# EAGLE schematic Mk4 Prototype (EAGLE 9.0.1) (continued)
## Sheet 3 of 4 (continued)
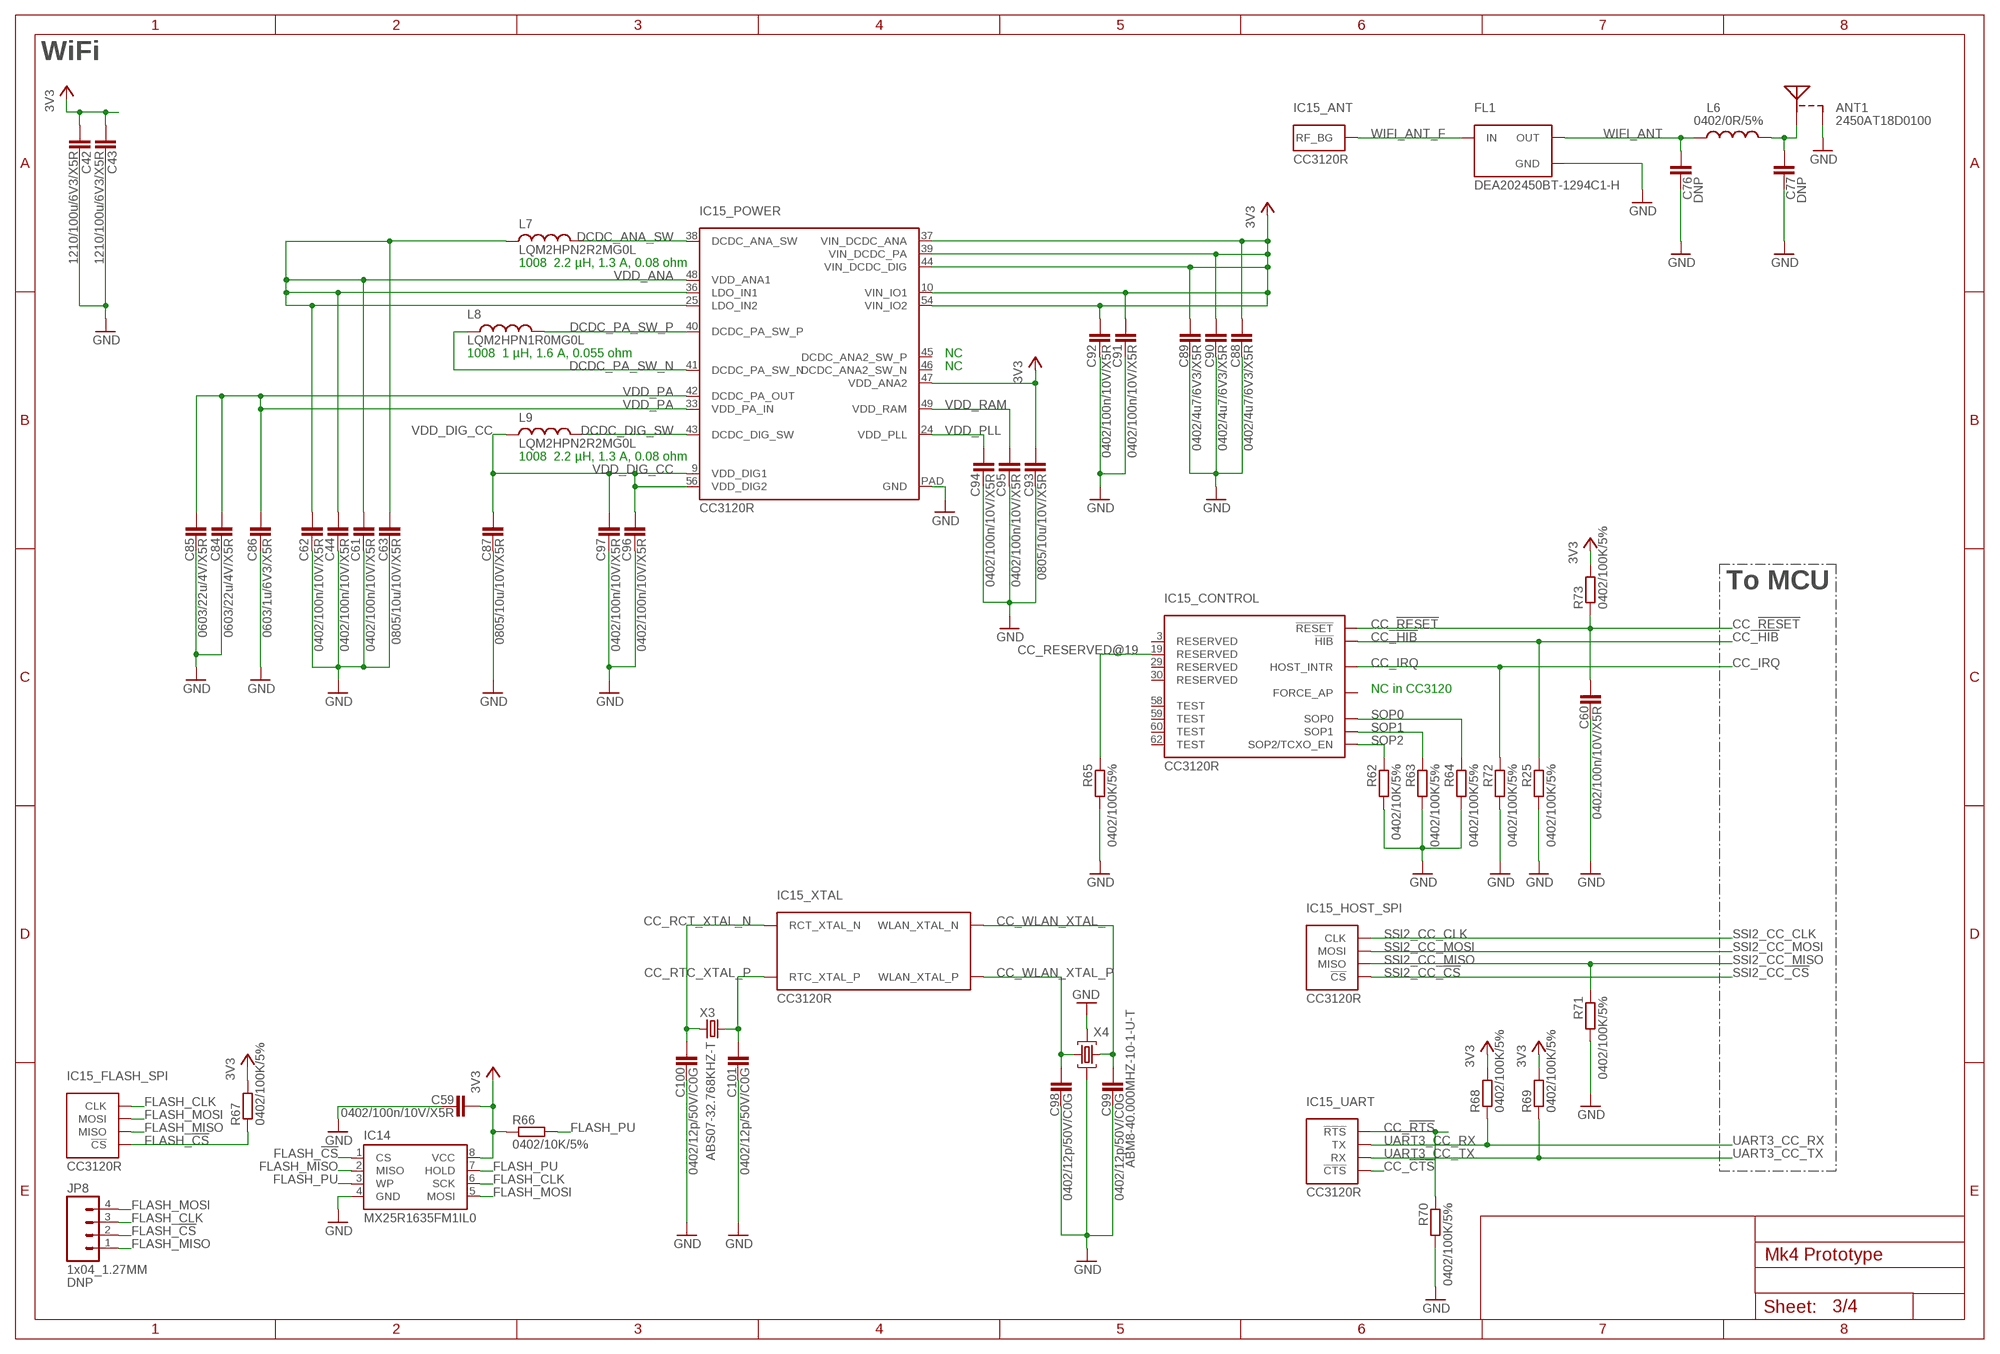
[diagram p2: schematic, sheet 3]

### Parts
ANT1  2450AT18D0100  CHIPANT_G-2450AT18D0100  [2450AT18D0100]
C42  1210/100u/6V3/X5R  C-EUC1210K  [C1210K]
C43  1210/100u/6V3/X5R  C-EUC1210K  [C1210K]
C44  0402/100n/10V/X5R  C-EUC0402-SMALLER  [C0402-SMALLER]
C59  0402/100n/10V/X5R  C-EUC0402-SMALLER  [C0402-SMALLER]
C60  0402/100n/10V/X5R  C-EUC0402-SMALLER  [C0402-SMALLER]
C61  0402/100n/10V/X5R  C-EUC0402-SMALLER  [C0402-SMALLER]
C62  0402/100n/10V/X5R  C-EUC0402-SMALLER  [C0402-SMALLER]
C63  0805/10u/10V/X5R  C-EUC0805-N  [C0805-N]
C76  C-EUC0402-SMALLER  [C0402-SMALLER]
C77  C-EUC0402-SMALLER  [C0402-SMALLER]
C84  0603/22u/4V/X5R  C-EUC0603K-SMALL  [C0603K-SMALL]
C85  0603/22u/4V/X5R  C-EUC0603K-SMALL  [C0603K-SMALL]
C86  0603/1u/6V3/X5R  C-EUC0603K-SMALL  [C0603K-SMALL]
C87  0805/10u/10V/X5R  C-EUC0805-N  [C0805-N]
C88  0402/4u7/6V3/X5R  C-EUC0402-SMALLER  [C0402-SMALLER]
C89  0402/4u7/6V3/X5R  C-EUC0402-SMALLER  [C0402-SMALLER]
C90  0402/4u7/6V3/X5R  C-EUC0402-SMALLER  [C0402-SMALLER]
C91  0402/100n/10V/X5R  C-EUC0402-SMALLER  [C0402-SMALLER]
C92  0402/100n/10V/X5R  C-EUC0402-SMALLER  [C0402-SMALLER]
C93  0805/10u/10V/X5R  C-EUC0805-N  [C0805-N]
C94  0402/100n/10V/X5R  C-EUC0402-SMALLER  [C0402-SMALLER]
C95  0402/100n/10V/X5R  C-EUC0402-SMALLER  [C0402-SMALLER]
C96  0402/100n/10V/X5R  C-EUC0402-SMALLER  [C0402-SMALLER]
C97  0402/100n/10V/X5R  C-EUC0402-SMALLER  [C0402-SMALLER]
C98  0402/12p/50V/C0G  C-EUC0402-SMALLER  [C0402-SMALLER]
C99  0402/12p/50V/C0G  C-EUC0402-SMALLER  [C0402-SMALLER]
C100  0402/12p/50V/C0G  C-EUC0402-SMALLER  [C0402-SMALLER]
C101  0402/12p/50V/C0G  C-EUC0402-SMALLER  [C0402-SMALLER]
FL1  DEA202450BT-1294C1-H  [DEA202450BT]
IC14  MX25R1635FM1IL0  SPI_FLASH-X25XXSMD1  [SO08-EIAJ]
IC15  CC3120R  CC3120  [VQFN-64]
JP8  1x04_1.27MM  M041.27MM  [1X04-1.27MM]
L6  0402/0R/5%  INDUCTOR-0402-NARROW  [L0402]
L7  LQM2HPN2R2MG0L  INDUCTOR1008  [1008]
L8  LQM2HPN1R0MG0L  INDUCTOR1008  [1008]
L9  LQM2HPN2R2MG0L  INDUCTOR1008  [1008]
R25  0402/100K/5%  R-EU_R0402-SMALLER  [R0402-SMALLER]
R62  0402/10K/5%  R-EU_R0402-SMALLER  [R0402-SMALLER]
R63  0402/100K/5%  R-EU_R0402-SMALLER  [R0402-SMALLER]
R64  0402/100K/5%  R-EU_R0402-SMALLER  [R0402-SMALLER]
R65  0402/100K/5%  R-EU_R0402-SMALLER  [R0402-SMALLER]
R66  0402/10K/5%  R-EU_R0402-SMALLER  [R0402-SMALLER]
R67  0402/100K/5%  R-EU_R0402-SMALLER  [R0402-SMALLER]
R68  0402/100K/5%  R-EU_R0402-SMALLER  [R0402-SMALLER]
R69  0402/100K/5%  R-EU_R0402-SMALLER  [R0402-SMALLER]
R70  0402/100K/5%  R-EU_R0402-SMALLER  [R0402-SMALLER]
R71  0402/100K/5%  R-EU_R0402-SMALLER  [R0402-SMALLER]
R72  0402/100K/5%  R-EU_R0402-SMALLER  [R0402-SMALLER]
R73  0402/100K/5%  R-EU_R0402-SMALLER  [R0402-SMALLER]
X3  ABS07-32.768KHZ-T  RESONATOR_EPSON_FC_145  [RESONATOR_EPSON_FC_145]
X4  ABM8-40.000MHZ-10-1-U-T  CRYSTAL-3.2-2.5  [CRYSTAL-3.2-2.5]

### Nets
3V3: C42.2 C43.2 C59.2 C88.1 C89.1 C90.1 C91.1 C92.1 C93.1 IC14.8(VCC) IC15.10(_POWER:VIN_IO1) IC15.37(_POWER:VIN_DCDC_ANA) IC15.39(_POWER:VIN_DCDC_PA) IC15.44(_POWER:VIN_DCDC_DIG) IC15.47(_POWER:VDD_ANA2) IC15.54(_POWER:VIN_IO2) R66.1 R67.2 R68.2 R69.2 R73.2 ; also sheet 1,2,4
CC_!CTS: IC15.61(_UART:!CTS)
CC_!HIB: IC15.2(_CONTROL:!HIB) R25.1 ; also sheet 1
CC_!RESET: C60.2 IC15.32(_CONTROL:!RESET) R73.1 ; also sheet 1
CC_!RTS: IC15.50(_UART:!RTS) R70.1
CC_IRQ: IC15.15(_CONTROL:HOST_INTR) R72.1 ; also sheet 1
CC_RCT_XTAL_N: C100.2 IC15.52(_XTAL:RCT_XTAL_N) X3.P$1
CC_RESERVED@19: IC15.19(_CONTROL:RESERVED) R65.1
CC_RTC_XTAL_P: C101.2 IC15.51(_XTAL:RTC_XTAL_P) X3.P$2
CC_WLAN_XTAL_: C99.2 IC15.22(_XTAL:WLAN_XTAL_N) X4.3(C2)
CC_WLAN_XTAL_P: C98.2 IC15.23(_XTAL:WLAN_XTAL_P) X4.1(C1)
DCDC_ANA_SW: IC15.38(_POWER:DCDC_ANA_SW) L7.2
DCDC_DIG_SW: IC15.43(_POWER:DCDC_DIG_SW) L9.2
DCDC_PA_SW_N: IC15.41(_POWER:DCDC_PA_SW_N) L8.1
DCDC_PA_SW_P: IC15.40(_POWER:DCDC_PA_SW_P) L8.2
FLASH_!CS: IC14.1(CS) IC15.14(_FLASH_SPI:!CS) JP8.2 R67.1
FLASH_CLK: IC14.6(SCK) IC15.11(_FLASH_SPI:CLK) JP8.3
FLASH_MISO: IC14.2(MISO) IC15.13(_FLASH_SPI:MISO) JP8.1
FLASH_MOSI: IC14.5(MOSI) IC15.12(_FLASH_SPI:MOSI) JP8.4
FLASH_PU: IC14.3(WP) IC14.7(HOLD) R66.2
GND: ANT1.2(GND) ANT1.3(GND) ANT1.4(GND) C42.1 C43.1 C44.2 C59.1 C60.1 C61.2 C62.2 C63.2 C76.1 C77.1 C84.2 C85.2 C86.2 C87.2 C88.2 C89.2 C90.2 C91.2 C92.2 C93.2 C94.2 C95.2 C96.2 C97.2 C98.1 C99.1 C100.1 C101.1 FL1.GND@2(GND) FL1.GND@4(GND) IC14.4(GND) IC15.PAD(_POWER:GND) R25.2 R62.2 R63.2 R64.2 R65.2 R70.2 R71.2 R72.2 X4.2(GND) X4.4(GND) ; also sheet 1,2,4
SOP0: IC15.35(_CONTROL:SOP0) R64.1
SOP1: IC15.34(_CONTROL:SOP1) R63.1
SOP2: IC15.21(_CONTROL:SOP2/TCXO_EN) R62.1
SSI2_CC_!CS: IC15.8(_HOST_SPI:!CS) ; also sheet 1
SSI2_CC_CLK: IC15.5(_HOST_SPI:CLK) ; also sheet 1
SSI2_CC_MISO: IC15.7(_HOST_SPI:MISO) R71.1 ; also sheet 1
SSI2_CC_MOSI: IC15.6(_HOST_SPI:MOSI) ; also sheet 1
UART3_CC_RX: IC15.55(_UART:TX) R68.1 ; also sheet 1
UART3_CC_TX: IC15.57(_UART:RX) R69.1 ; also sheet 1
VDD_ANA: C44.1 C61.1 C62.1 C63.1 IC15.25(_POWER:LDO_IN2) IC15.36(_POWER:LDO_IN1) IC15.48(_POWER:VDD_ANA1) L7.1
VDD_DIG_CC: C87.1 C96.1 C97.1 IC15.9(_POWER:VDD_DIG1) IC15.56(_POWER:VDD_DIG2) L9.1
VDD_PA: C84.1 C85.1 C86.1 IC15.33(_POWER:VDD_PA_IN) IC15.42(_POWER:DCDC_PA_OUT)
VDD_PLL: C94.1 IC15.24(_POWER:VDD_PLL)
VDD_RAM: C95.1 IC15.49(_POWER:VDD_RAM)
WFIF_ANT_L [50R Single]: ANT1.1 C77.2 L6.2
WIFI_ANT [50R Single]: C76.2 FL1.OUT L6.1
WIFI_ANT_F [50R Single]: FL1.IN IC15.31(_ANT:RF_BG)
Unconnected: IC15.3(_CONTROL:RESERVED) IC15.4(_CONTROL:FORCE_AP) IC15.29(_CONTROL:RESERVED) IC15.30(_CONTROL:RESERVED) IC15.58(_CONTROL:TEST) IC15.59(_CONTROL:TEST) IC15.60(_CONTROL:TEST) IC15.62(_CONTROL:TEST)

### Notes on the sheet
- WiFi
- 1008  2.2 µH, 1.3 A, 0.08 ohm
- 1008  1 µH, 1.6 A, 0.055 ohm | NC
- NC
- 1008  2.2 µH, 1.3 A, 0.08 ohm
- To MCU
- NC in CC3120

## Sheet 4 of 4
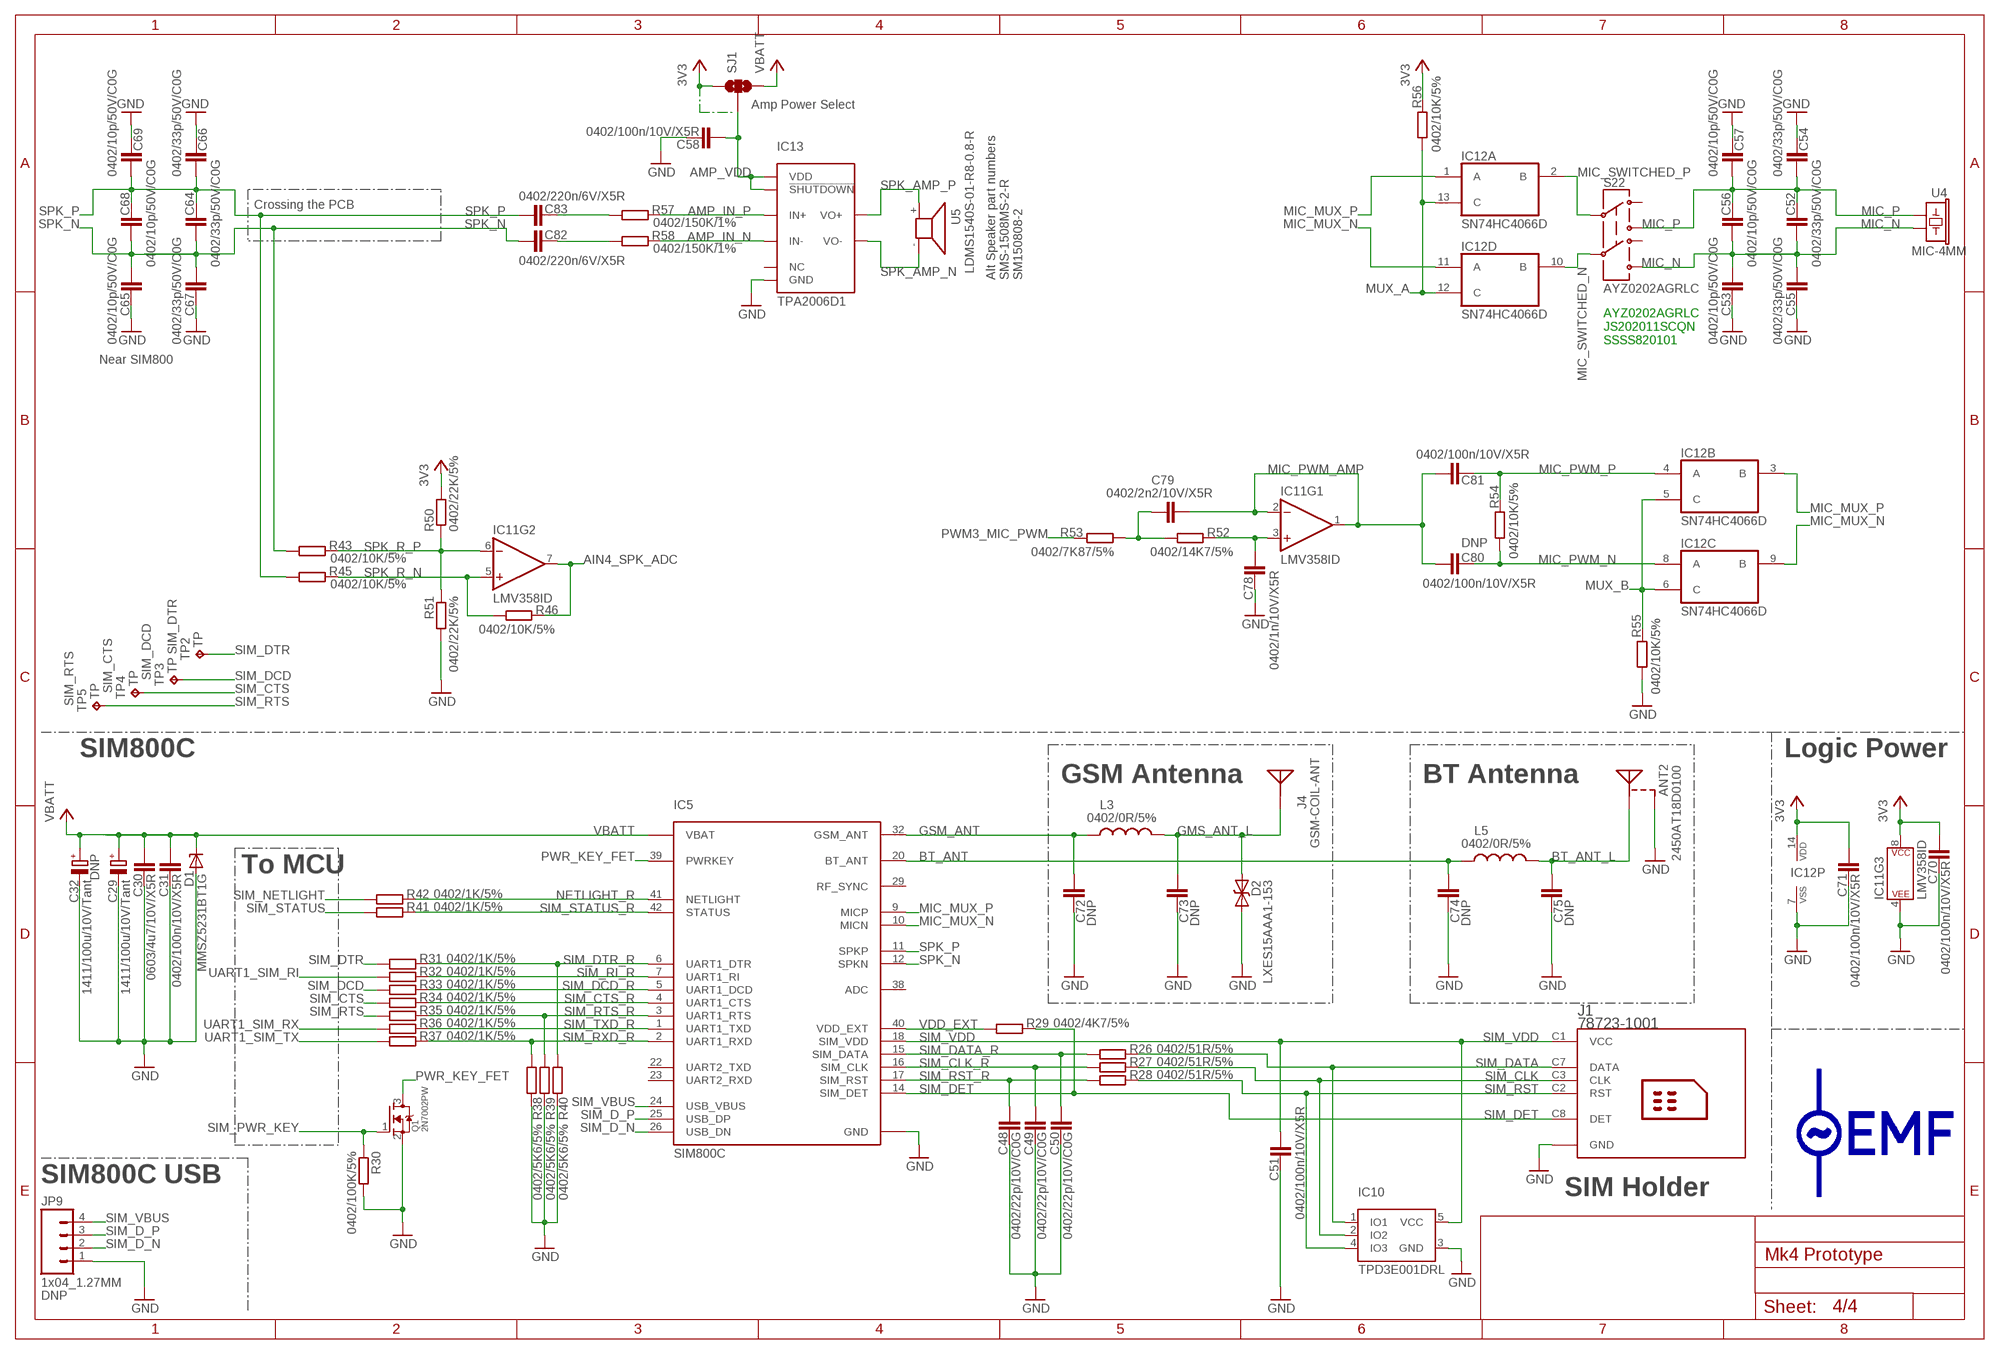
[diagram p3: schematic, sheet 4]

### Parts
ANT2  2450AT18D0100  CHIPANT_G-2450AT18D0100  [2450AT18D0100]
C29  1411/100u/10V/Tant  CPOL-EUCT3528  [CT3528]
C30  0603/4u7/10V/X5R  C-EUC0603K-SMALL  [C0603K-SMALL]
C31  0402/100n/10V/X5R  C-EUC0402-SMALLER  [C0402-SMALLER]
C32  1411/100u/10V/Tant  CPOL-EUCT3528  [CT3528]
C48  0402/22p/10V/C0G  C-EUC0402-SMALLER  [C0402-SMALLER]
C49  0402/22p/10V/C0G  C-EUC0402-SMALLER  [C0402-SMALLER]
C50  0402/22p/10V/C0G  C-EUC0402-SMALLER  [C0402-SMALLER]
C51  0402/100n/10V/X5R  C-EUC0402-SMALLER  [C0402-SMALLER]
C52  0402/33p/50V/C0G  C-EUC0402-SMALLER  [C0402-SMALLER]
C53  0402/10p/50V/C0G  C-EUC0402-SMALLER  [C0402-SMALLER]
C54  0402/33p/50V/C0G  C-EUC0402-SMALLER  [C0402-SMALLER]
C55  0402/33p/50V/C0G  C-EUC0402-SMALLER  [C0402-SMALLER]
C56  0402/10p/50V/C0G  C-EUC0402-SMALLER  [C0402-SMALLER]
C57  0402/10p/50V/C0G  C-EUC0402-SMALLER  [C0402-SMALLER]
C58  0402/100n/10V/X5R  C-EUC0402-SMALLER  [C0402-SMALLER]
C64  0402/33p/50V/C0G  C-EUC0402-SMALLER  [C0402-SMALLER]
C65  0402/10p/50V/C0G  C-EUC0402-SMALLER  [C0402-SMALLER]
C66  0402/33p/50V/C0G  C-EUC0402-SMALLER  [C0402-SMALLER]
C67  0402/33p/50V/C0G  C-EUC0402-SMALLER  [C0402-SMALLER]
C68  0402/10p/50V/C0G  C-EUC0402-SMALLER  [C0402-SMALLER]
C69  0402/10p/50V/C0G  C-EUC0402-SMALLER  [C0402-SMALLER]
C70  0402/100n/10V/X5R  C-EUC0402-SMALLER  [C0402-SMALLER]
C71  0402/100n/10V/X5R  C-EUC0402-SMALLER  [C0402-SMALLER]
C72  C-EUC0402-SMALLER  [C0402-SMALLER]
C73  C-EUC0402-SMALLER  [C0402-SMALLER]
C74  C-EUC0402-SMALLER  [C0402-SMALLER]
C75  C-EUC0402-SMALLER  [C0402-SMALLER]
C78  0402/1n/10V/X5R  C-EUC0402-SMALLER  [C0402-SMALLER]
C79  0402/2n2/10V/X5R  C-EUC0402-SMALLER  [C0402-SMALLER]
C80  0402/100n/10V/X5R  C-EUC0402-SMALLER  [C0402-SMALLER]
C81  0402/100n/10V/X5R  C-EUC0402-SMALLER  [C0402-SMALLER]
C82  0402/220n/6V/X5R  C-EUC0402-SMALLER  [C0402-SMALLER]
C83  0402/220n/6V/X5R  C-EUC0402-SMALLER  [C0402-SMALLER]
D1  MMSZ5231BT1G  DIODE-ZENER-SOD123  [SOD123]
D2  LXES15AAA1-153  DIODE-TVS-BI-0402  [R0402-SMALLER]
IC5  SIM800C  [SIM800C]
IC10  TPD3E001DRL  [DRL-5]
IC11  LMV358ID  OPAMP-DUAL-U  [SO08]
IC12  SN74HC4066D  4066D  [SO14]
IC13  TPA2006D1  [VSON-8]
J1  78723-1001  SIM-78723-1001-LWK  [MSIM-MOLEX-LWK]
J4  GSM-COIL-ANT  ANTENNA-GSM  [GSM-ANTENNA]
JP9  1x04_1.27MM  M041.27MM  [1X04-1.27MM]
L3  0402/0R/5%  INDUCTOR-0402-NARROW  [L0402]
L5  0402/0R/5%  INDUCTOR-0402-NARROW  [L0402]
Q1  2N7002PW  MOSFET-N-SC70-3  [SC70-3-R]
R26  0402/51R/5%  R-EU_R0402-SMALLER  [R0402-SMALLER]
R27  0402/51R/5%  R-EU_R0402-SMALLER  [R0402-SMALLER]
R28  0402/51R/5%  R-EU_R0402-SMALLER  [R0402-SMALLER]
R29  0402/4K7/5%  R-EU_R0402-SMALLER  [R0402-SMALLER]
R30  0402/100K/5%  R-EU_R0402-SMALLER  [R0402-SMALLER]
R31  0402/1K/5%  R-EU_R0402-SMALLER  [R0402-SMALLER]
R32  0402/1K/5%  R-EU_R0402-SMALLER  [R0402-SMALLER]
R33  0402/1K/5%  R-EU_R0402-SMALLER  [R0402-SMALLER]
R34  0402/1K/5%  R-EU_R0402-SMALLER  [R0402-SMALLER]
R35  0402/1K/5%  R-EU_R0402-SMALLER  [R0402-SMALLER]
R36  0402/1K/5%  R-EU_R0402-SMALLER  [R0402-SMALLER]
R37  0402/1K/5%  R-EU_R0402-SMALLER  [R0402-SMALLER]
R38  0402/5K6/5%  R-EU_R0402-SMALLER  [R0402-SMALLER]
R39  0402/5K6/5%  R-EU_R0402-SMALLER  [R0402-SMALLER]
R40  0402/5K6/5%  R-EU_R0402-SMALLER  [R0402-SMALLER]
R41  0402/1K/5%  R-EU_R0402-SMALLER  [R0402-SMALLER]
R42  0402/1K/5%  R-EU_R0402-SMALLER  [R0402-SMALLER]
R43  0402/10K/5%  R-EU_R0402-SMALLER  [R0402-SMALLER]
R45  0402/10K/5%  R-EU_R0402-SMALLER  [R0402-SMALLER]
R46  0402/10K/5%  R-EU_R0402-SMALLER  [R0402-SMALLER]
R50  0402/22K/5%  R-EU_R0402-SMALLER  [R0402-SMALLER]
R51  0402/22K/5%  R-EU_R0402-SMALLER  [R0402-SMALLER]
R52  0402/14K7/5%  R-EU_R0402-SMALLER  [R0402-SMALLER]
R53  0402/7K87/5%  R-EU_R0402-SMALLER  [R0402-SMALLER]
R54  0402/10K/5%  R-EU_R0402-SMALLER  [R0402-SMALLER]
R55  0402/10K/5%  R-EU_R0402-SMALLER  [R0402-SMALLER]
R56  0402/10K/5%  R-EU_R0402-SMALLER  [R0402-SMALLER]
R57  0402/150K/1%  R-EU_R0402-SMALLER  [R0402-SMALLER]
R58  0402/150K/1%  R-EU_R0402-SMALLER  [R0402-SMALLER]
S22  AYZ0202AGRLC  SWITCH-DPDT-AYZ-JS-COMBINED  [AYZ-JS-COMBINED]
SJ1  Amp Power Select  SOLDERJUMPER_2WAYS  [SJ_3]
TP2  TP  TPB1,27  [B1,27]
TP3  TP  TPB1,27  [B1,27]
TP4  TP  TPB1,27  [B1,27]
TP5  TP  TPB1,27  [B1,27]
U4  MIC-4MM  [MIC-SMD-4MM]
U5  LDMS1540S-01-R8-0.8-R  SPEAKER-15MM-SMD  [SPEAKER-15MM-SMD]

### Nets
3V3: C70.2 C71.2 IC11.8(P$V+) IC12.14(P:VDD) R50.2 R56.2 SJ1.1 ; also sheet 1,2,3
AIN4_SPK_ADC: IC11.7(OUT) R46.2 ; also sheet 1
AMP_IN_N [Audio]: IC13.4(IN-) R58.2
AMP_IN_P [Audio]: IC13.3(IN+) R57.2
AMP_IN_R_N [Audio]: C82.1 R58.1
AMP_IN_R_P [Audio]: C83.1 R57.1
AMP_VDD: C58.1 IC13.1(!SHUTDOWN) IC13.6(VDD) SJ1.2
BT_ANT [50R Single]: C74.2 IC5.20(BT_ANT) L5.1
BT_ANT_L [50R Single]: ANT2.1 C75.2 L5.2
GMS_ANT_L [50R Single]: C73.2 D2.1 J4.ANT L3.2
GND: ANT2.2(GND) ANT2.3(GND) ANT2.4(GND) C29.- C30.1 C31.1 C32.- C48.1 C49.1 C50.1 C51.1 C53.2 C54.2 C55.2 C57.2 C58.2 C65.2 C66.2 C67.2 C69.2 C70.1 C71.1 C72.1 C73.1 C74.1 C75.1 C78.1 D1.A D2.2 IC5.8(GND) IC5.13(GND) IC5.19(GND) IC5.21(GND) IC5.27(GND) IC5.30(GND) IC5.31(GND) IC5.33(GND) IC5.36(GND) IC5.37(GND) IC10.3(GND) IC11.4(P$V-) IC12.7(P:VSS) IC13.7(GND) IC13.PAD(GND) J1.C4(GND) J1.C5(GND) J1.GND1(GND) J1.GND2(GND) J1.GND3(GND) J1.GND4(GND) J1.GND5(GND) J1.GND6(GND) JP9.1 Q1.2(S) R30.2 R38.2 R39.2 R40.2 R51.2 R55.1 ; also sheet 1,2,3
GSM_ANT [50R Single]: C72.2 IC5.32(GSM_ANT) L3.1
MIC_MUX_N [Audio]: IC5.10(MICN) IC12.9(C:B) IC12.11(D:A)
MIC_MUX_P [Audio]: IC5.9(MICP) IC12.1(A:A) IC12.3(B:B)
MIC_N [Audio]: C52.2 C53.1 C55.1 C56.2 S22.6 U4.-
MIC_P [Audio]: C52.1 C54.1 C56.1 C57.1 S22.3 U4.+
MIC_PWM_AMP: C79.1 C80.2 C81.2 IC11.1(OUT) IC11.2(-IN)
MIC_PWM_AMP_+: C78.2 IC11.3(+IN) R52.2
MIC_PWM_N [Audio]: C80.1 IC12.8(C:A) R54.1
MIC_PWM_P [Audio]: C81.1 IC12.4(B:A) R54.2
MIC_PWM_R: C79.2 R52.1 R53.1
MIC_SWITCHED_N [Audio]: IC12.10(D:B) S22.5
MIC_SWITCHED_P [Audio]: IC12.2(A:B) S22.2
MUX_A: IC12.12(D:C) IC12.13(A:C) R56.1 ; also sheet 1
MUX_B: IC12.5(B:C) IC12.6(C:C) R55.2 ; also sheet 1
NETLIGHT_R: IC5.41(NETLIGHT) R42.2
PWM3_MIC_PWM: R53.2 ; also sheet 1
PWR_KEY_FET: IC5.39(PWRKEY) Q1.3(D)
SIM_CLK: IC10.2(IO2) J1.C3(CLK) R27.2
SIM_CLK_R: C49.2 IC5.16(SIM_CLK) R27.1
SIM_CTS: R34.1 TP4.TP
SIM_CTS_R: IC5.4(UART1_CTS) R34.2
SIM_D_N [90R Diff]: IC5.26(USB_DN) JP9.2
SIM_D_P [90R Diff]: IC5.25(USB_DP) JP9.3
SIM_DATA: IC10.1(IO1) J1.C7(DATA) R26.2
SIM_DATA_R: C50.2 IC5.15(SIM_DATA) R26.1
SIM_DCD: R33.1 TP3.TP
SIM_DCD_R: IC5.5(UART1_DCD) R33.2
SIM_DET: IC5.14(SIM_DET) J1.C8(DET) R29.2
SIM_DTR: R31.1 TP2.TP
SIM_DTR_R: IC5.6(UART1_DTR) R31.2 R40.1
SIM_NETLIGHT: R42.1 ; also sheet 1
SIM_PWR_KEY: Q1.1(G) R30.1 ; also sheet 1
SIM_RI_R: IC5.7(UART1_RI) R32.2
SIM_RST: IC10.4(IO3) J1.C2(RST) R28.2
SIM_RST_R: C48.2 IC5.17(SIM_RST) R28.1
SIM_RTS: R35.1 TP5.TP
SIM_RTS_R: IC5.3(UART1_RTS) R35.2 R39.1
SIM_RXD_R: IC5.2(UART1_RXD) R37.2 R38.1
SIM_STATUS: R41.1 ; also sheet 1
SIM_STATUS_R: IC5.42(STATUS) R41.2
SIM_TXD_R: IC5.1(UART1_TXD) R36.2
SIM_VBUS: IC5.24(USB_VBUS) JP9.4
SIM_VDD: C51.2 IC5.18(SIM_VDD) IC10.5(VCC) J1.C1(VCC)
SPK_AMP_N [Audio]: IC13.8(VO-) U5.-
SPK_AMP_P [Audio]: IC13.5(VO+) U5.+
SPK_N [Audio]: C64.2 C65.1 C67.1 C68.2 C82.2 IC5.12(SPKN) R43.1
SPK_P [Audio]: C64.1 C66.1 C68.1 C69.1 C83.2 IC5.11(SPKP) R45.1
SPK_R_N: IC11.5(+IN) R45.2 R46.1
SPK_R_P: IC11.6(-IN) R43.2 R50.1 R51.1
UART1_SIM_RI: R32.1 ; also sheet 1
UART1_SIM_RX: R36.1 ; also sheet 1
UART1_SIM_TX: R37.1 ; also sheet 1
VBATT: C29.+ C30.2 C31.2 C32.+ D1.C IC5.34(VBAT) IC5.35(VBAT) SJ1.3 ; also sheet 2
VDD_EXT: IC5.40(VDD_EXT) R29.1
Unconnected: IC5.22(UART2_TXD) IC5.23(UART2_RXD) IC5.29(RF_SYNC) IC5.38(ADC) IC13.2(NC) S22.1 S22.4

### Notes on the sheet
- Crossing the PCB
- Alt Speaker part numbers
  SMS-1508MS-2-R
  SM150808-2
- AYZ0202AGRLC
  JS202011SCQN
  SSSS820101
- Near SIM800
- SIM800C | Logic Power
- GSM Antenna | BT Antenna
- To MCU
- SIM800C USB
- SIM Holder

## Power pins joined to a net without a drawn wire
DCDC_ANA2_SW_N: IC15.46(_POWER:DCDC_ANA2_SW_N)
DCDC_ANA2_SW_P: IC15.45(_POWER:DCDC_ANA2_SW_P)

## Library data of the parts
ANT1 ANT2 = TiLDA Mk4 Parts:CHIPANT_G
ARTWORK1 ARTWORK2 = TiLDA Mk4 Parts:ARTWORK; DNP: Y
BATT = TiLDA Mk4 Parts:BATTERY-OUTLINE
C1-C28 C30 C31 C33-C71 C78 C79 C81-C104 = TiLDA Mk4 Parts:C-EU: CAPACITOR, European symbol
C29 = TiLDA Mk4 Parts:CPOL-EU: POLARIZED CAPACITOR, European symbol
C32 = TiLDA Mk4 Parts:CPOL-EU: POLARIZED CAPACITOR, European symbol; DNP: Y
C72-C77 C80 = TiLDA Mk4 Parts:C-EU: CAPACITOR, European symbol; DNP: Y
D1 = TiLDA Mk4 Parts:DIODE-ZENER-: DIODE
D2 = TiLDA Mk4 Parts:DIODE-TVS-BI-: Schottky Bidirectional Diode
FID1-FID6 = TiLDA Mk4 Parts:FIDUCIAL: Fiducial Alignment Points Various fiducial points for machine vision alignment.; DNP: Y
FL1 = TiLDA Mk4 Parts:DEA202450BT-1294C1-H
IC1 = TiLDA Mk4 Parts:MSP432E401
IC2 = TiLDA Mk4 Parts:MT48LCXXM16A2
IC3 = TiLDA Mk4 Parts:TPS62882
IC4 = TiLDA Mk4 Parts:TCA9555
IC5 = TiLDA Mk4 Parts:SIM800C
IC6 IC14 = TiLDA Mk4 Parts:SPI_FLASH-X25XX: 8pin SPI Flash series x25xx. Works with devices like W25X32 and BR25L32
IC7 IC10 = TiLDA Mk4 Parts:TPD3E001
IC8 = TiLDA Mk4 Parts:BQ25601
IC9 = TiLDA Mk4 Parts:OPT3001
IC11 = TiLDA Mk4 Parts:OPAMP-DUAL: Generic op-amp footprint This component is for the standard 358 pinning of a dual op-amp From the LM358 datasheet: Pin 1: Output A Pin 2: Inverting Input A Pin 3: Non-Inverting Input A Pin 4: Gnd Pin 5: Non-Inverting Input B Pin 6: Inverting Input B Pin 7: Output B Pin 8: V+
IC12 = TiLDA Mk4 Parts:4066: Quad bilateral ANALOG SWITCH
IC13 = TiLDA Mk4 Parts:TPA2006D1
IC15 = TiLDA Mk4 Parts:CC3120
J1 = TiLDA Mk4 Parts:SIM-78723-1001
J2 = TiLDA Mk4 Parts:ER-TFT024-3
J3 = TiLDA Mk4 Parts:SWD_SHROUD; DNP: Y
J4 = TiLDA Mk4 Parts:ANTENNA
J5 = TiLDA Mk4 Parts:M02: Header 2 Standard 2-pin 0.1" header. Use with straight break away headers (SKU : PRT-00116), right angle break away headers (PRT-00553), swiss pins (PRT-00743), machine pins (PRT-00117), and female headers (PRT-00115). Molex polarized connector foot print use with SKU : PRT-08233 with associated crimp pins and housings.
JP2 = TiLDA Mk4 Parts:M03: Header 3 Standard 3-pin 0.1" header. Use with straight break away headers (SKU : PRT-00116), right angle break away headers (PRT-00553), swiss pins (PRT-00743), machine pins (PRT-00117), and female headers (PRT-00115). Molex polarized connector foot print use with SKU : PRT-08232 with associated crimp pins and housings.; DNP: Y
JP3 = TiLDA Mk4 Parts:M02: Header 2 Standard 2-pin 0.1" header. Use with straight break away headers (SKU : PRT-00116), right angle break away headers (PRT-00553), swiss pins (PRT-00743), machine pins (PRT-00117), and female headers (PRT-00115). Molex polarized connector foot print use with SKU : PRT-08233 with associated crimp pins and housings.; DNP: Y
JP4 = TiLDA Mk4 Parts:TC2030-SWD; DNP: Y
JP7 = TiLDA Mk4 Parts:M14: Header 14 Standard 14-pin 0.1" header. Use with straight break away headers (SKU : PRT-00116), right angle break away headers (PRT-00553), swiss pins (PRT-00743), machine pins (PRT-00117), and female headers (PRT-00115).; DNP: Y
JP8 JP9 = TiLDA Mk4 Parts:M04: Header 4 Standard 4-pin 0.1" header. Use with straight break away headers (SKU : PRT-00116), right angle break away headers (PRT-00553), swiss pins (PRT-00743), machine pins (PRT-00117), and female headers (PRT-00115). Molex polarized connector foot print use with SKU : PRT-08231 with associated crimp pins and housings. 1MM SMD Version SKU: PRT-10208; DNP: Y
L1 L3-L9 = TiLDA Mk4 Parts:INDUCTOR: Inductors Basic Inductor/Choke - 0603 and 1206. Footprints are not proven and vary greatly between part numbers.
L2 = TiLDA Mk4 Parts:WE-CBF: SMD EMI Suppression Ferrite Beads - excellent anti-EMI properties - low DCR - impedances till 3000 ohms - rated current up to 6 A
LAYERS1 = TiLDA Mk4 Parts:LAYER_NUMBRS; DNP: Y
LCD = TiLDA Mk4 Parts:ER-TFT024-3-OUTLINE
LED1 LED2 = TiLDA Mk4 Parts:WS2812B: WS2812B - Intelligent control LED integrated light source Technical Specifications: Power Supply Voltage (VDD): 3.5 to 5.3 V Input Voltage (VI): -0.5 to VDD+0.5 V Operating Junction Temperature (Topt): -25°C to +80°C Storage Temperature Range (Tstg): -55°C to +150°C
LED3 LED6 = TiLDA Mk4 Parts:LED: LEDs Standard schematic elements and footprints for 5mm, 3mm, 1206, and 0603 sized LEDs. 5mm - Spark Fun Electronics SKU : COM-00529 (and others); COLOUR: RED
LED4 = TiLDA Mk4 Parts:LED: LEDs Standard schematic elements and footprints for 5mm, 3mm, 1206, and 0603 sized LEDs. 5mm - Spark Fun Electronics SKU : COM-00529 (and others); COLOUR: GREEN
LED5 = TiLDA Mk4 Parts:LED: LEDs Standard schematic elements and footprints for 5mm, 3mm, 1206, and 0603 sized LEDs. 5mm - Spark Fun Electronics SKU : COM-00529 (and others); DNP: Y
LOGO1 = TiLDA Mk4 Parts:EMFLOGO
PCB = TiLDA Mk4 Parts:TILDA_MK3_BOARDOUTLINE
Q1 Q2 = TiLDA Mk4 Parts:MOSFET-N: N-Channel Mosfet 2N7002E - 60V 260mA SOT23 [Digikey: 2N7002ET1GOSTR-ND] - REEL BSH103 - 30V 850mA SOT23 [Digikey: 568-5013-1-ND]
Q3 = TiLDA Mk4 Parts:CSD25402Q3A
Q8 = TiLDA Mk4 Parts:CSD13202Q2
R1-R10 R12-R73 = TiLDA Mk4 Parts:R-EU_: RESISTOR, European symbol
R11 = TiLDA Mk4 Parts:R-EU_: RESISTOR, European symbol; DNP: Y
S1-S17 S19 = TiLDA Mk4 Parts:TAC_SWITCH1
S18 = TiLDA Mk4 Parts:SWITCH-SPST: SPST Switch Simple slide switch. Spark Fun Electronics SKU : COM-00102
S20 = TiLDA Mk4 Parts:TAC_SWITCH1; DNP: Y
S22 = TiLDA Mk4 Parts:SWITCH-DPDT: DPDT Version of the COM-00597
SJ1 = TiLDA Mk4 Parts:SOLDERJUMPER_2WAY: Solder Jumper 2 way solder jumper; DNP: Y
SW1 = TiLDA Mk4 Parts:JOYSTICK_MINI
TP1 = TiLDA Mk4 Parts:TP: Test pad; TP_SIGNAL_NAME: !HIB
TP2 = TiLDA Mk4 Parts:TP: Test pad; TP_SIGNAL_NAME: SIM_DTR
TP3 = TiLDA Mk4 Parts:TP: Test pad; TP_SIGNAL_NAME: SIM_DCD
TP4 = TiLDA Mk4 Parts:TP: Test pad; TP_SIGNAL_NAME: SIM_CTS
TP5 = TiLDA Mk4 Parts:TP: Test pad; TP_SIGNAL_NAME: SIM_RTS
TP6 = TiLDA Mk4 Parts:TP: Test pad; TP_SIGNAL_NAME: USB_ID
TP7 = TiLDA Mk4 Parts:TP: Test pad; TP_SIGNAL_NAME: USB_VBUS
U1 = TiLDA Mk4 Parts:USB-AB: This is a USB AB connector that is compatible with USB OTG. i.e. this connector can serve as a host or device
U2 = TiLDA Mk4 Parts:TMP102
U4 = TiLDA Mk4 Parts:MIC: Microphone
U5 = TiLDA Mk4 Parts:SPEAKER
X1 X3 = TiLDA Mk4 Parts:RESONATOR_EPSON_FC_145
X2 X4 = TiLDA Mk4 Parts:CRYSTAL

## Net classes
1 50R Single: width 0.4 mm, clearance 0.4 mm to class 0, clearance 0.4 mm
2 90R Diff: width 0.25 mm, clearance 0.25 mm to class 0, clearance 0.4 mm to class 1, clearance 0.15 mm
3 100R Diff: width 0.22 mm, clearance 0.25 mm to class 0, clearance 0.4 mm to class 1, clearance 0.25 mm to class 2, clearance 0.15 mm
4 Audio: width 0.2 mm, clearance 0.25 mm to class 0, clearance 0.4 mm to class 1, clearance 0.25 mm to class 2, clearance 0.25 mm to class 3, clearance 0.15 mm